# EasyEDA Pro project Dart25-有控镖航电系统.eprj, board PCB7
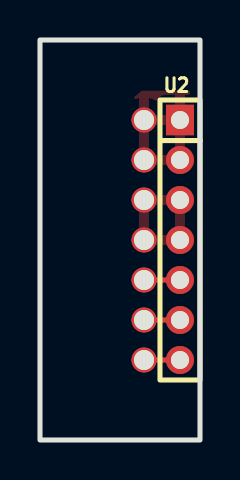
[diagram p12: board, top side]
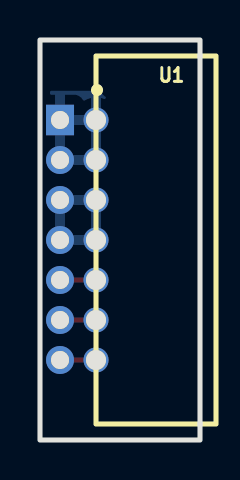
[diagram p13: board, bottom side, seen from below]

Outline 8 x 20 mm; copper layers: Top Layer, Bottom Layer. Coordinates in mm from the lower left corner of the outline.
Outline path: rectangle 0,20 8,0
Stack: Top Layer 0.035mm / Dielectric1 1.51mm FR4 er 4.5 / Bottom Layer 0.035mm

## Design rules (mm)
template: 自定义配置
spacing copperThickness1oz (default): track to track 0.102, other pairs 0.152 to 0.3
spacing copperThickness2oz: track to track 0.203, other pairs 0.152 to 0.3
track width copperThickness1oz (default): min 0.127, default 0.254, max 2.54
track width copperThickness2oz: min 0.203, default 0.254, max 2.54
differential pair differentialPair (default): width min 0.127, default 0.254, max 2.54; gap min 0.152, default 0.152
via viaSize (default): diameter min 0.5, default 0.61, max 10; hole min 0.3, default 0.305, max 6.3
net $1N156 uses copperRegion1
net $1N166 uses copperRegion1

## Placement (name value [footprint] x y rotation side)
U1  DS-A11F-C-8P-S2  [CONN-TH_8P-P2.00_DS-A11F-C-7P-L1]  2.2 10 270 bottom
U2  XDZ200-1-07-Z-2.0-G1  [HDR-TH_7P-P2.00-V-M]  7 10 270 top

## Footprints (pads in the part's own frame, mm; a bottom-side part is the same pattern mirrored in y, then rotated)
CONN-TH_8P-P2.00_DS-A11F-C-7P-L1
  round 1.254 hole 1: 1(-6,-3) 2(-4,-3) 3(-2,-3) 4(0,-3) 5(2,-3) 6(4,-3) 7(6,-3)
HDR-TH_7P-P2.00-V-M
  rect 1.524x1.4 hole 0.9: 1(-6,0)
  round 1.4 hole 0.9: 2(-4,0) 3(-2,0) 4(0,0) 5(2,0) 6(4,0) 7(6,0)

## Nets
As in the schematic.

## Routing (per net, layer and track width the routed paths; a pad name or vN(x,y) marks a point on that pad's centre or on a via; arc(x,y) is an arc through that point)
$1N148: length 1.8
  Top Layer w0.254: U2.5 U1.5
$1N150: length 1.8
  Top Layer w0.254: U2.6 U1.6
$1N152: length 1.8
  Top Layer w0.254: U1.7 U2.7

## Copper pours and planes (outline as drawn; the poured copper is in the pictures)
$1N156 on Top Layer: 5.08,17.46 4.06,16.59 4.06,13.78 4.7,13.14 7.49,13.14 8.13,13.78 8.13,16.83 7.49,17.46
$1N156 on Bottom Layer: 5.08,17.46 4.06,16.59 4.06,13.78 4.7,13.14 7.49,13.14 8.13,13.78 8.13,16.83 7.49,17.46
$1N166 on Top Layer: 4.91,12.88 4.19,12.26 4.19,9.57 4.7,9.07 7.36,9.07 7.87,9.58 7.87,12.88
$1N166 on Bottom Layer: 4.91,12.88 4.19,12.26 4.19,9.57 4.7,9.07 7.36,9.07 7.87,9.58 7.87,12.88
